# EasyEDA Pro project test_0.eprj

# Schematic Schematic1

## Sheets
1 P1: Create Date: 2024-12-12; Page Name: P1; Project Name: test_0; Schematic Name: Schematic1; Update Date: 2025-02-14; Company: 嘉立创EDA; Page Size: A4; Version: V1.0
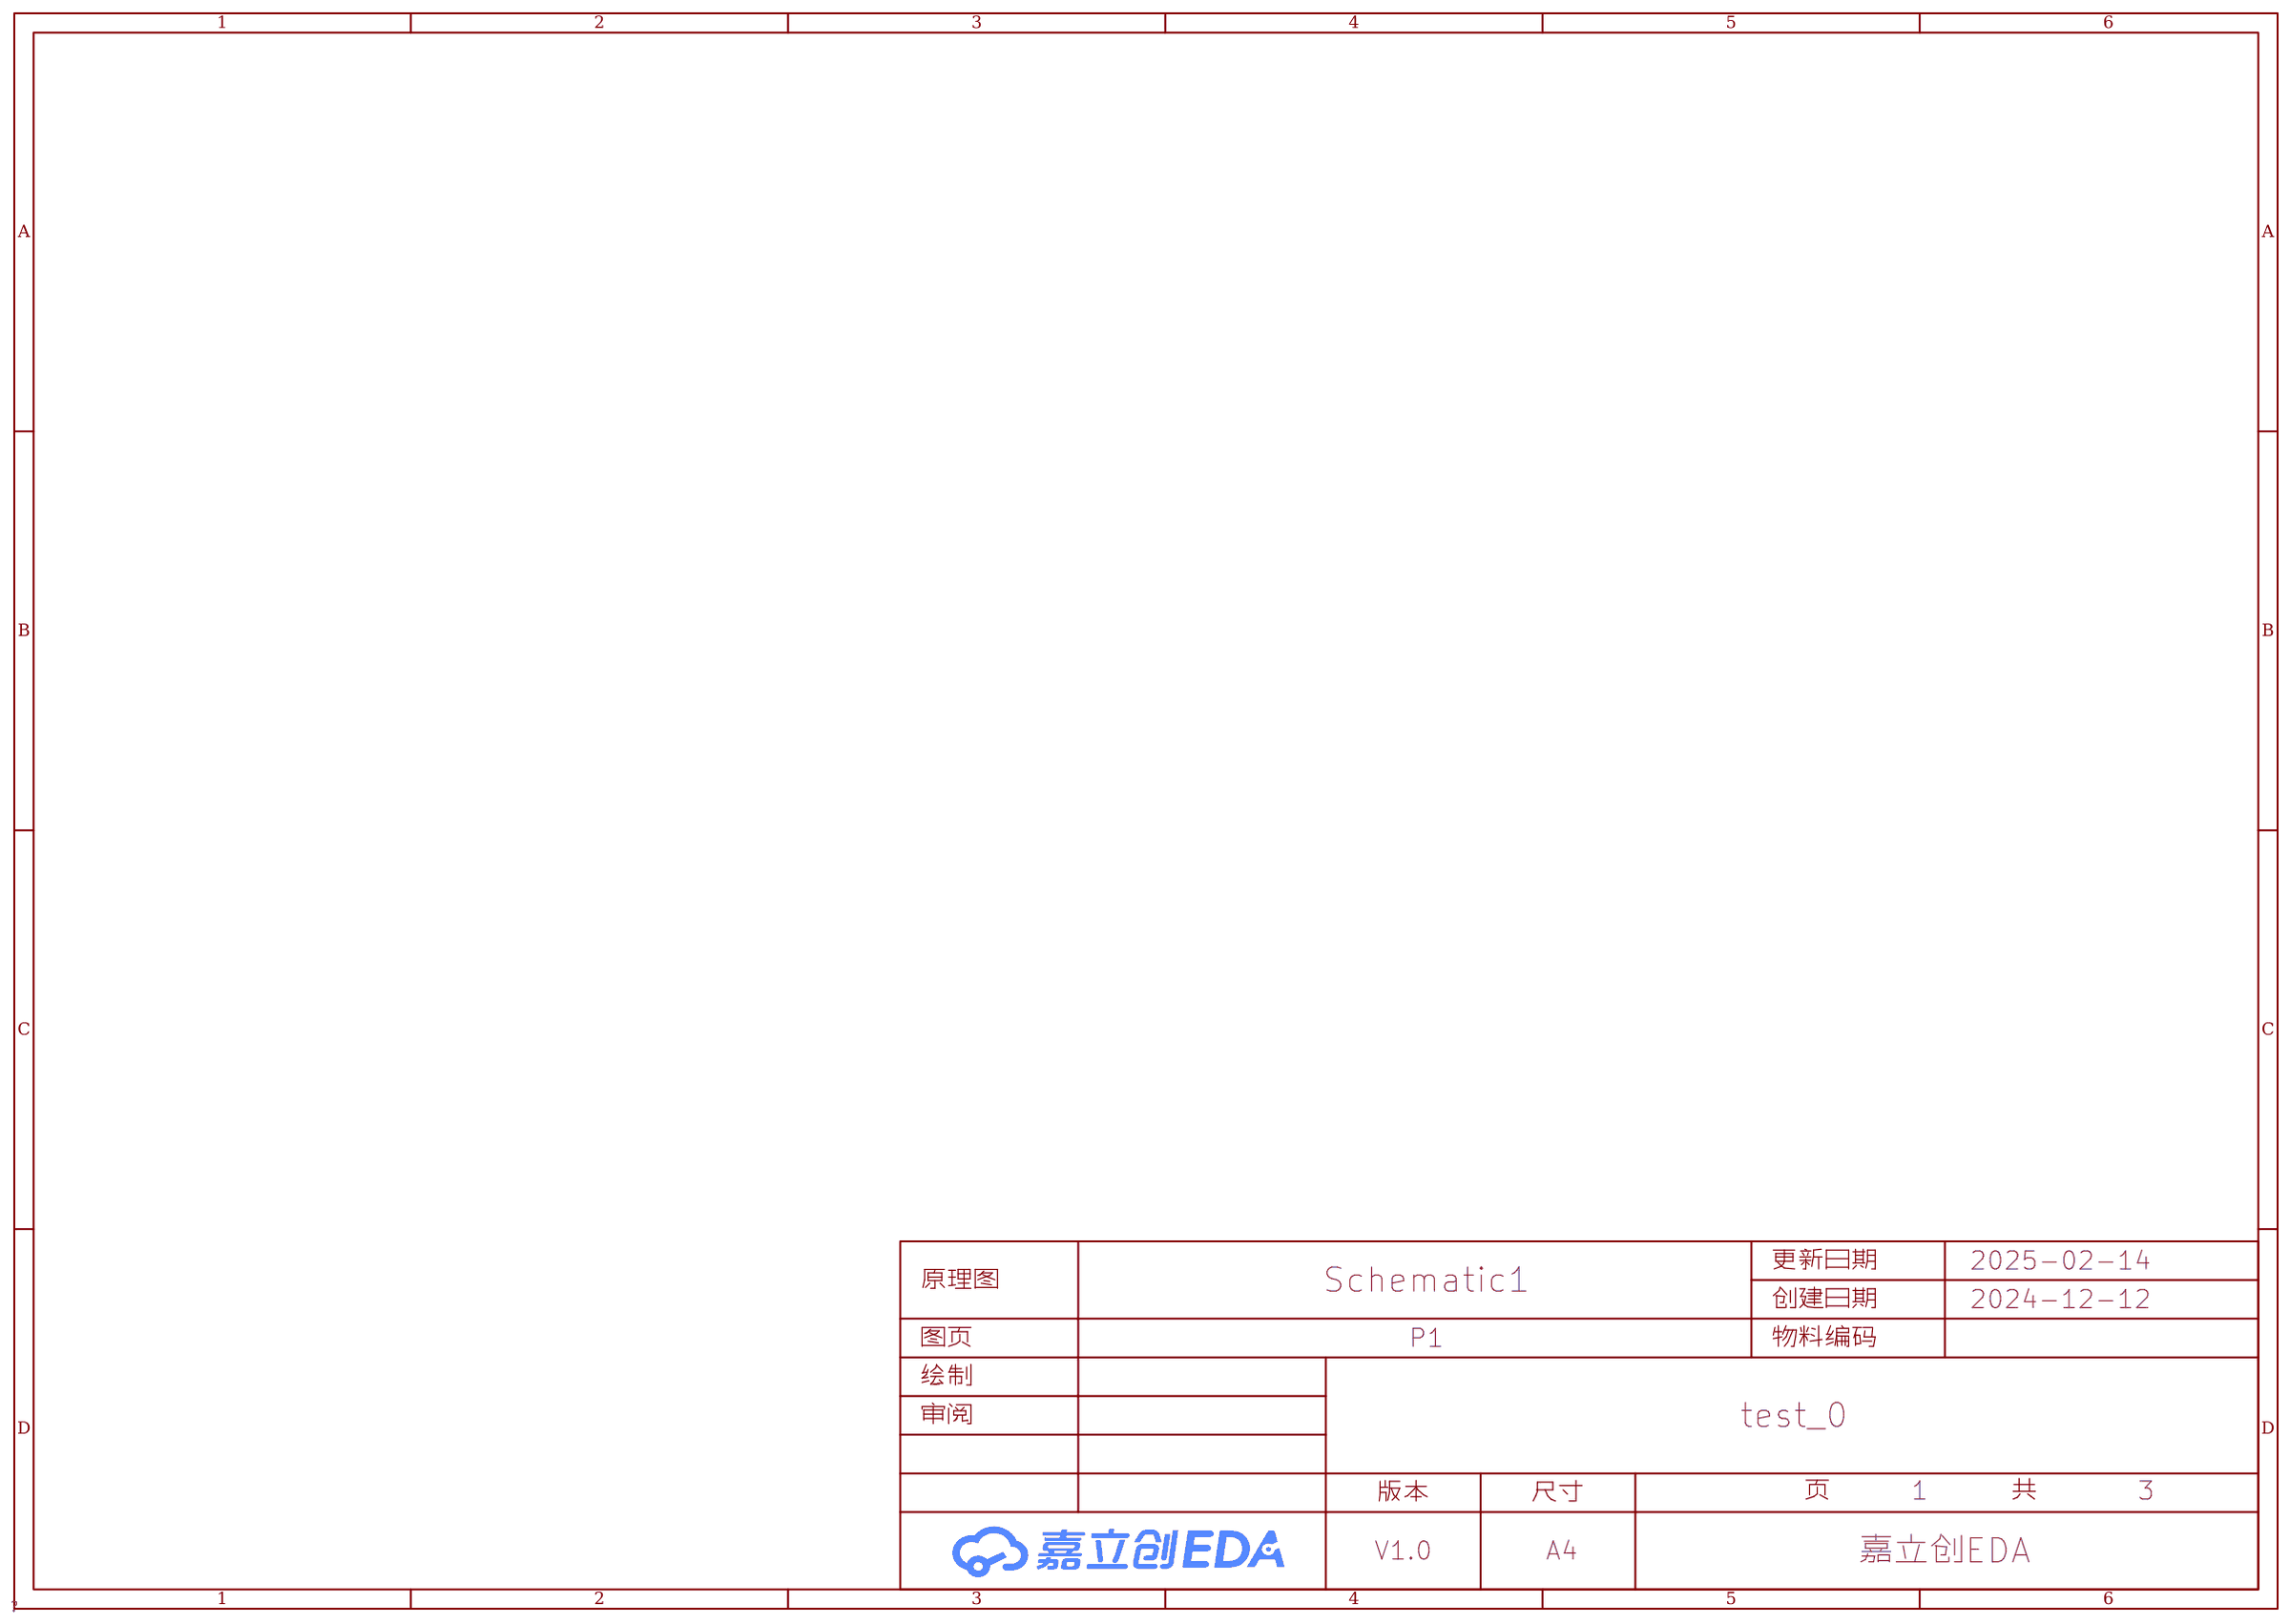
[diagram p0: P1]
2 P2: Create Date: 2024-12-15; Page Name: P2
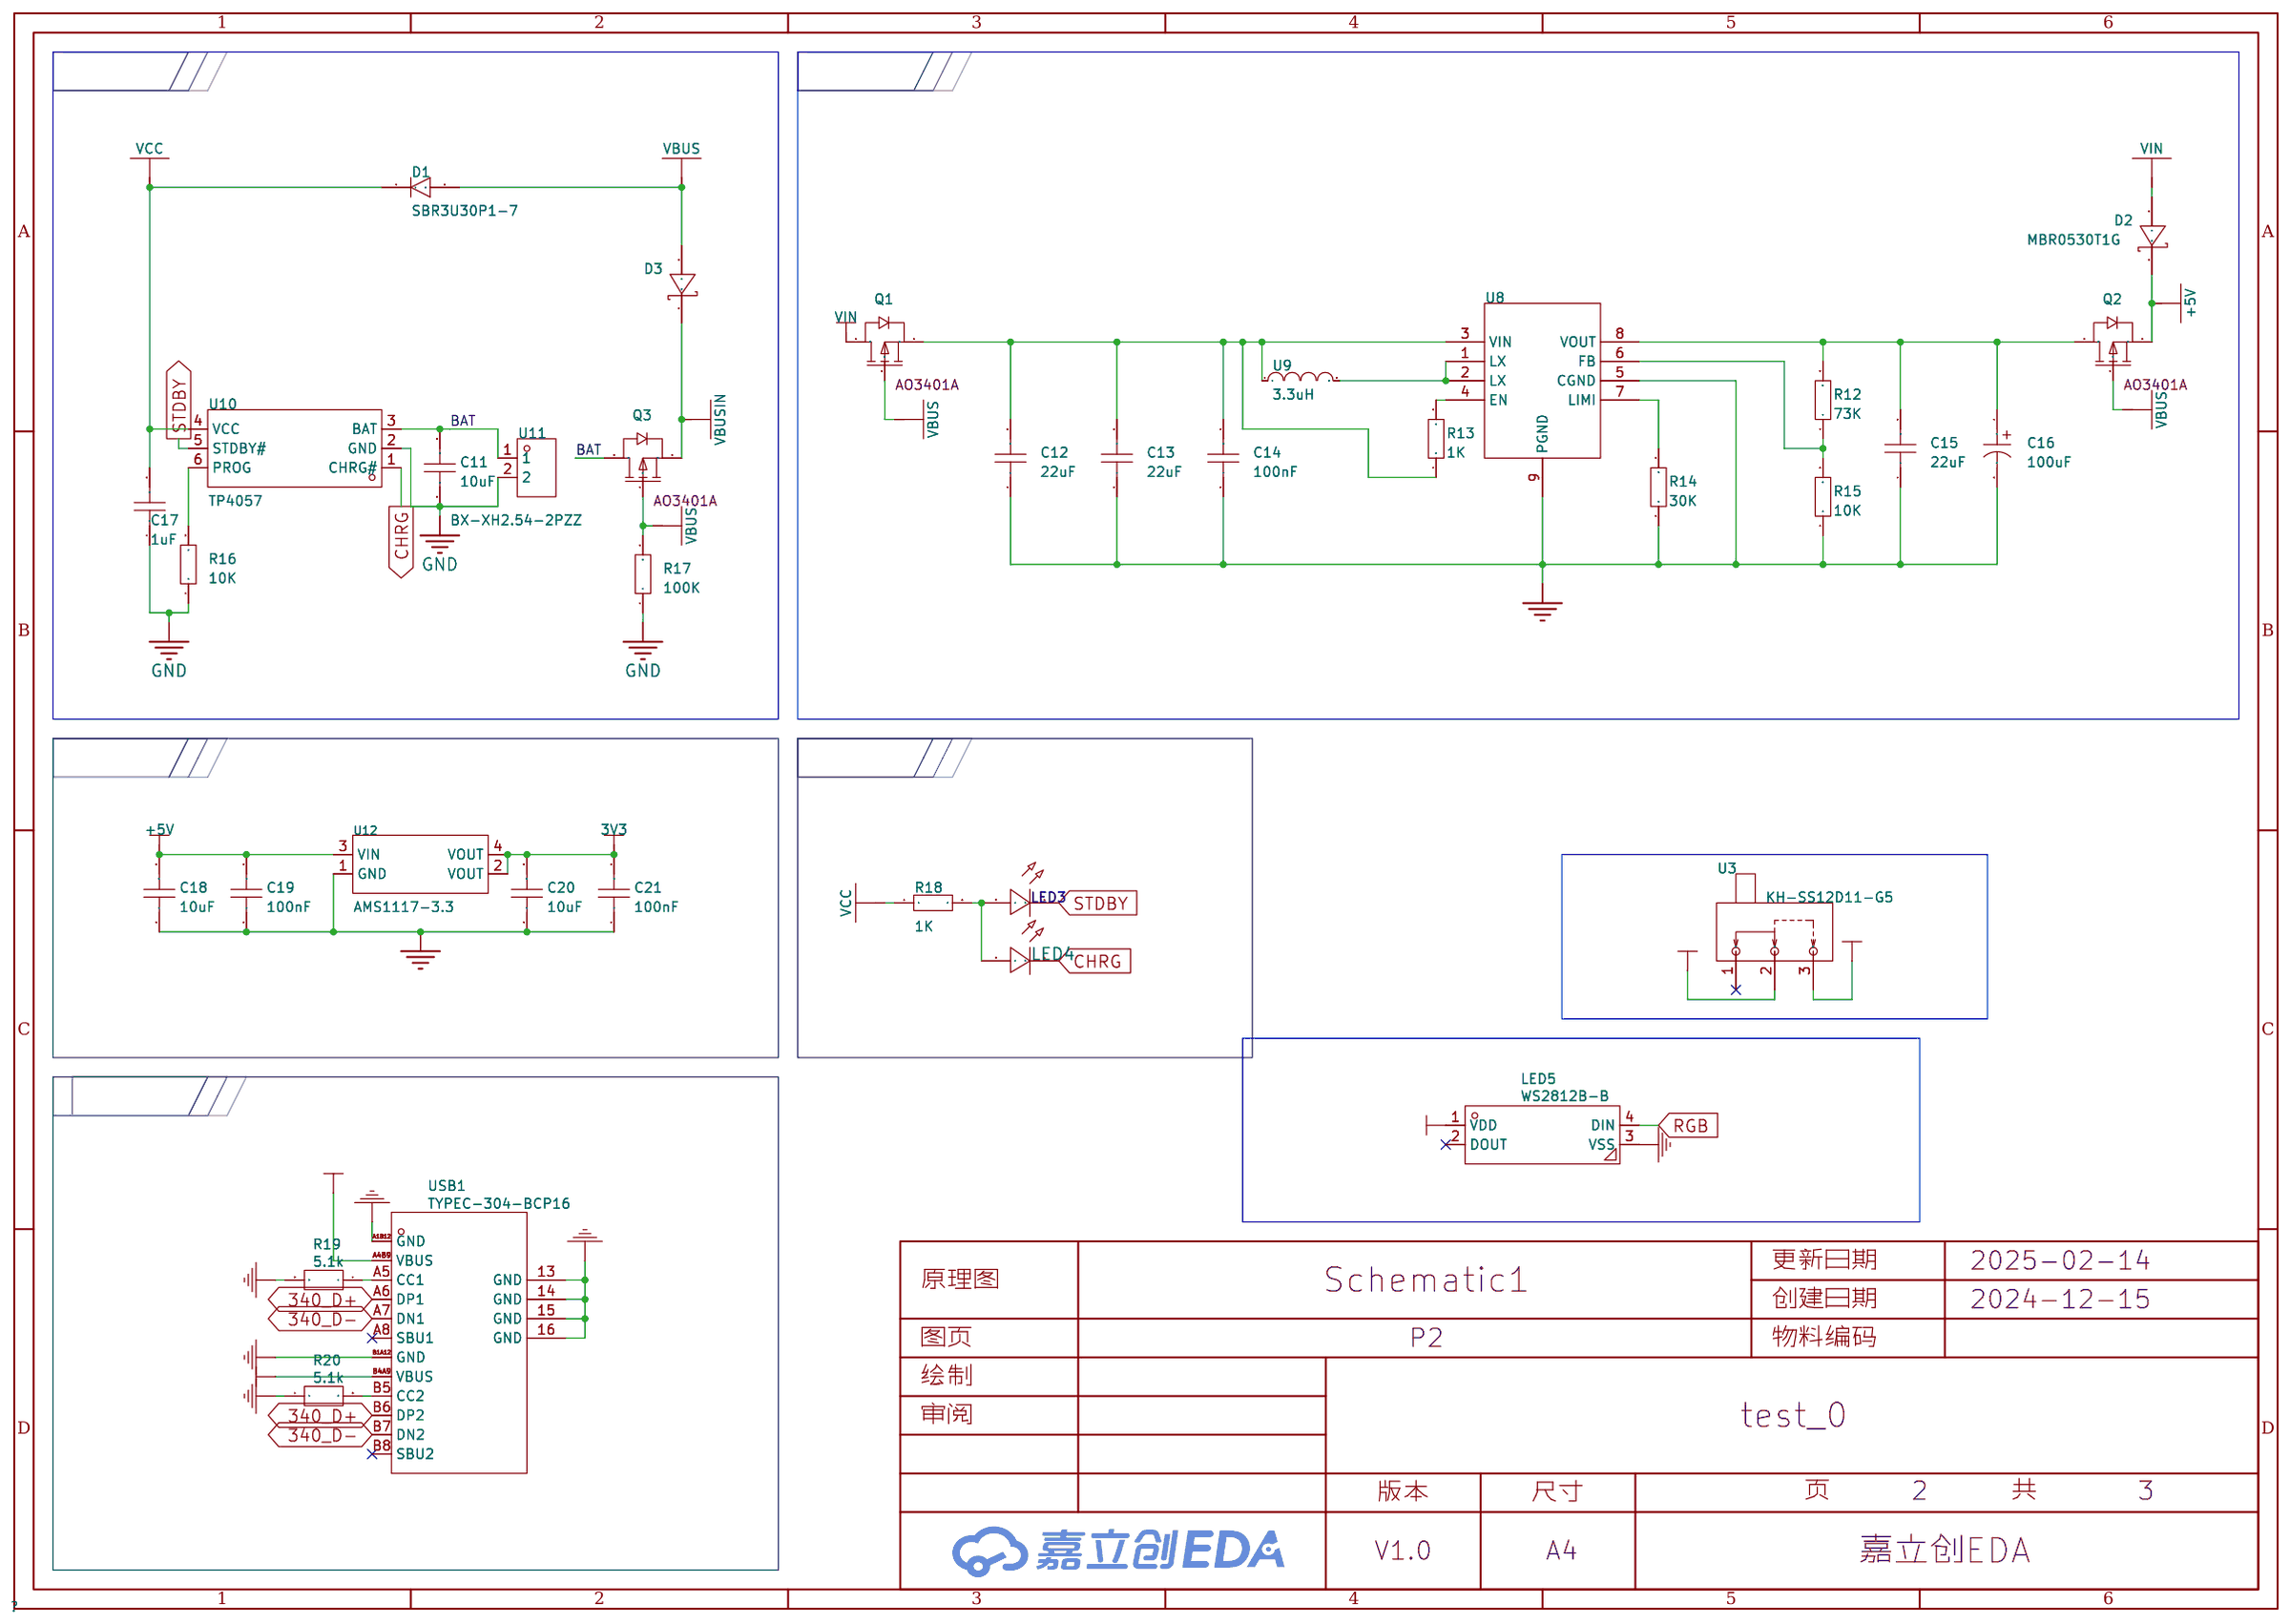
[diagram p1: P2]
3 P3: Create Date: 2025-01-15; Page Name: P3; Update Date: 2025-02-06
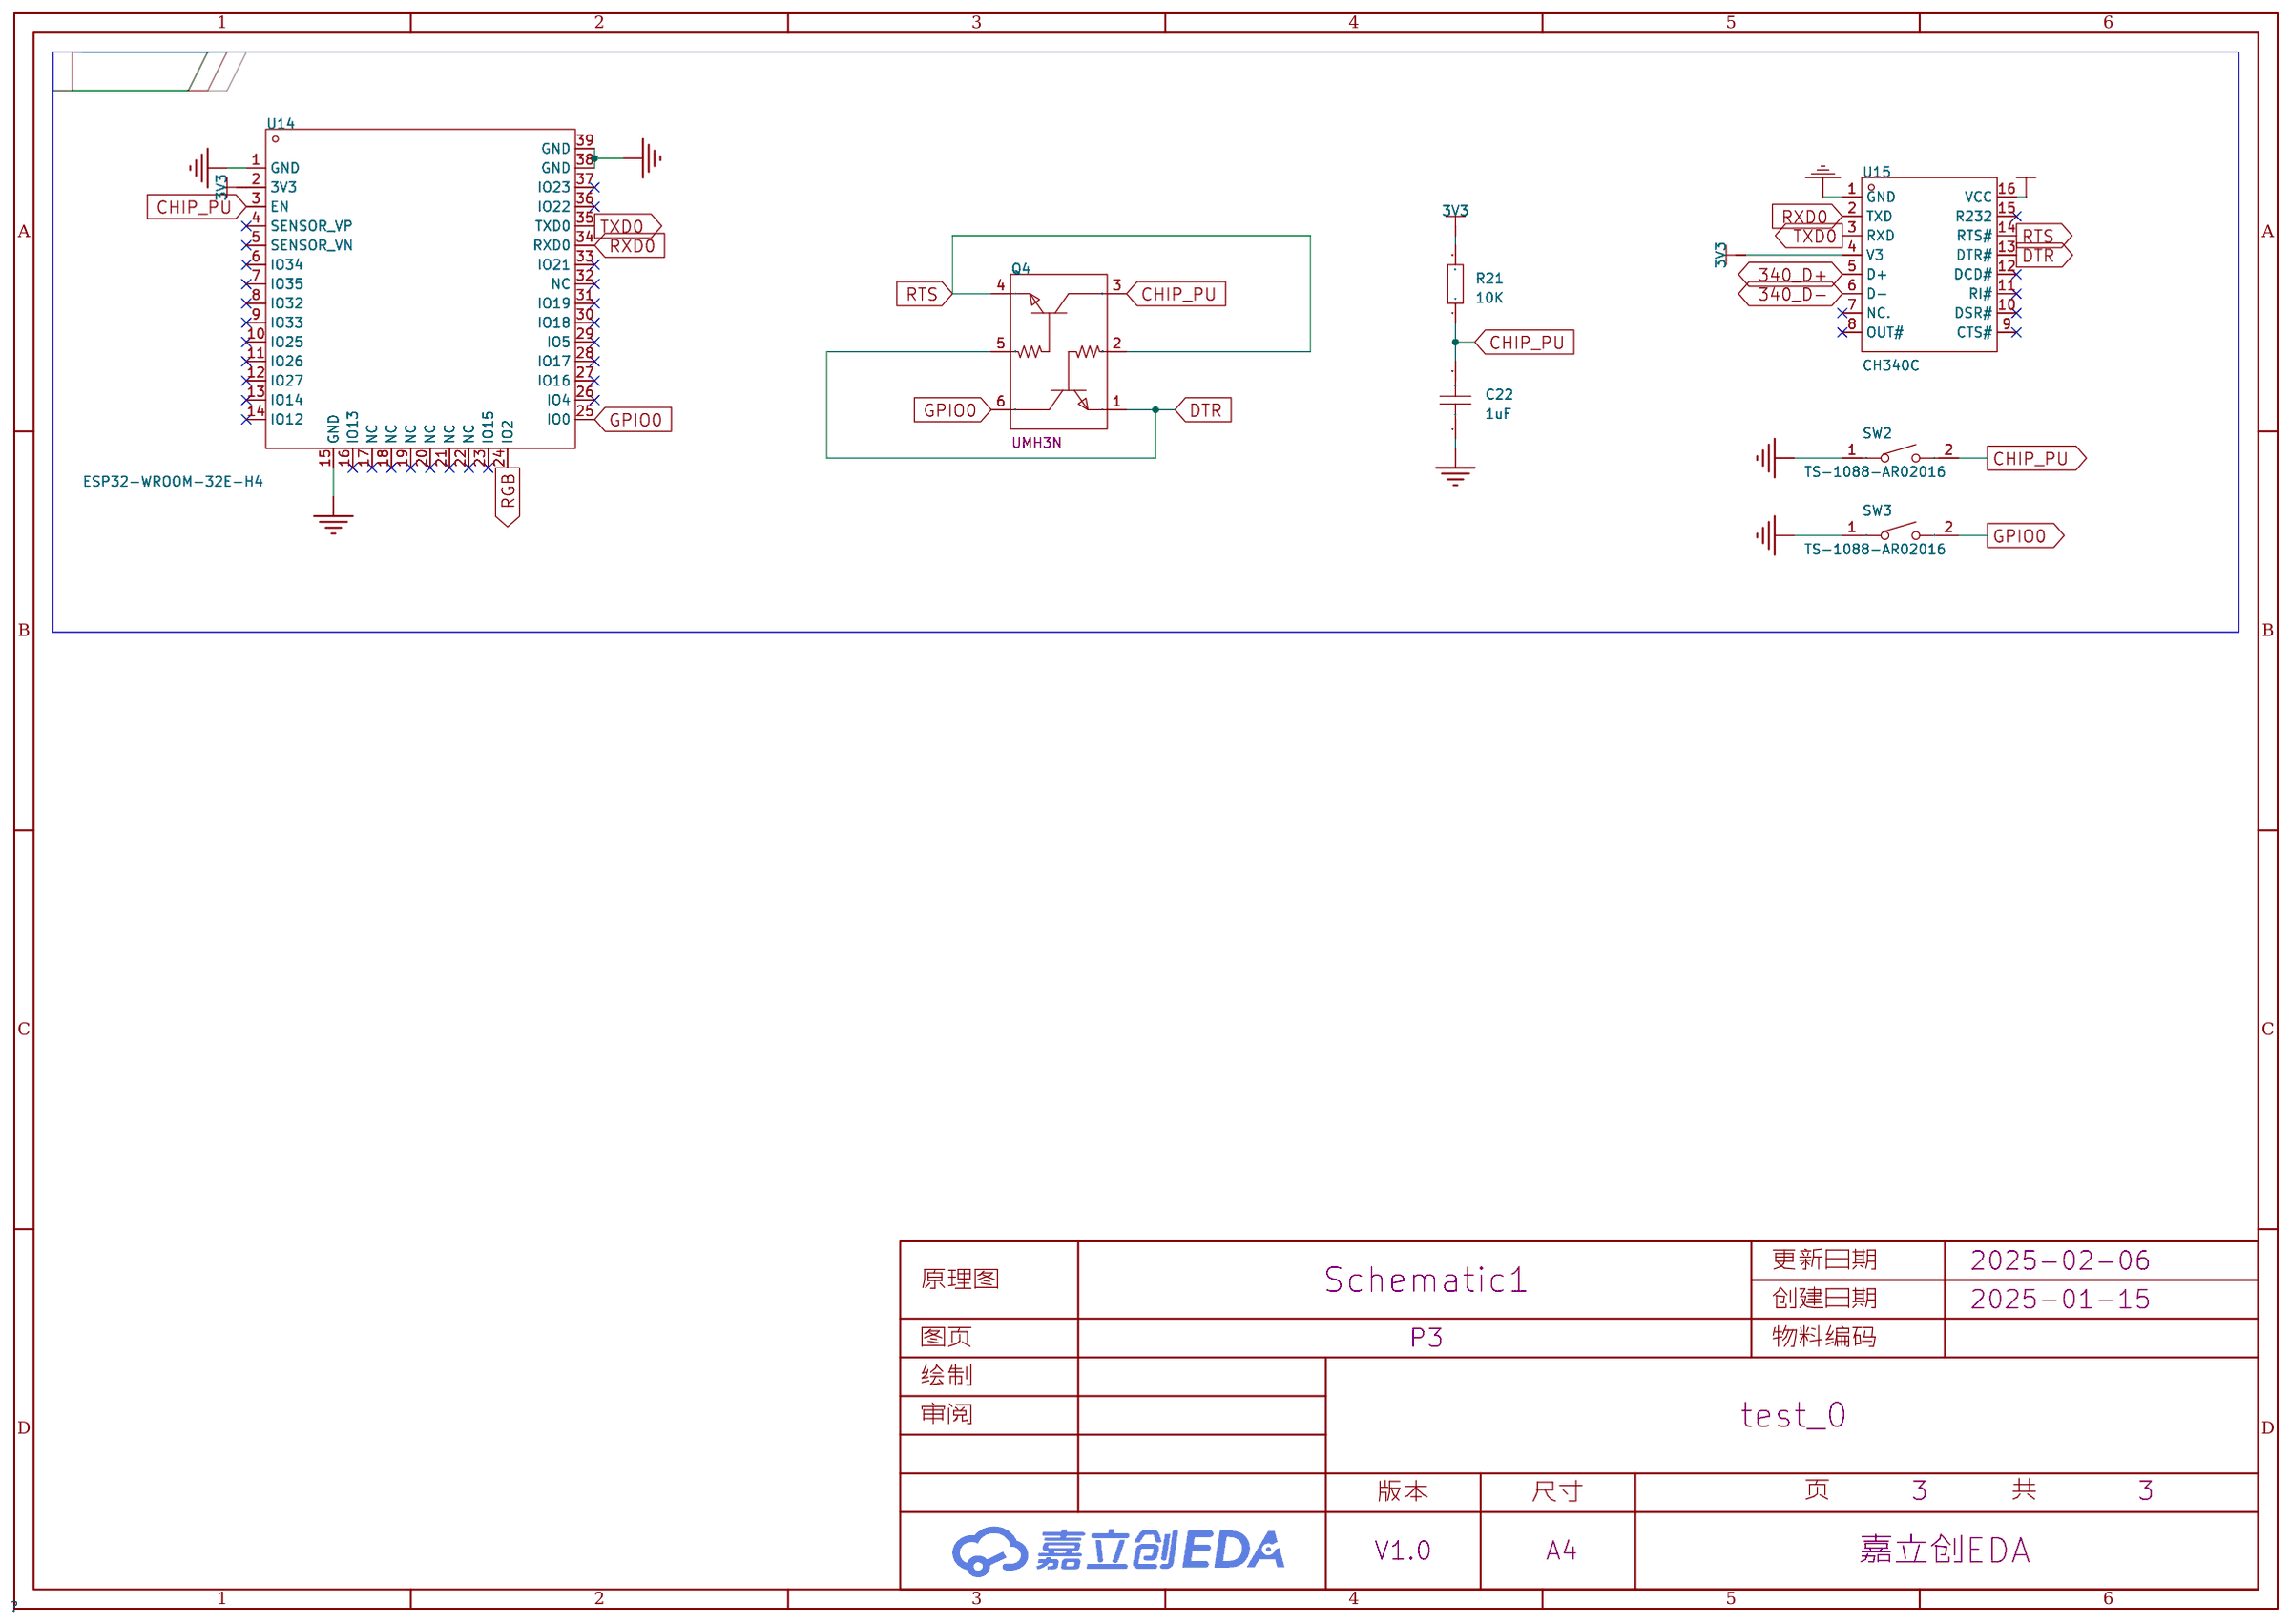
[diagram p2: P3]

## Parts
sheet P2
C11  10uF  [C0805]
C12  22uF  [C0805]
C13  22uF  [C0805]
C14  100nF  [C0805]
C15  22uF  [C0805]
C16  100uF  [CAP-TH_BD5.0-P2.00-D0.5-FD]
C17  1uF  [C0805]
C18  10uF  [C0805]
C19  100nF  [C0805]
C20  10uF  [C0805]
C21  100nF  [C0805]
D1  SBR3U30P1-7  [POWERDI-123_L2.8-W1.8-LS3.7-RD-1]
D2  MBR0530T1G  [SOD-123_L2.7-W1.6-LS3.7-RD-1]
D3  MBR0530T1G  [SOD-123_L2.7-W1.6-LS3.7-RD-1]
LED3  -  [LED_0805]
LED4  -  [LED_0805]
LED5  WS2812B-B  [LED-SMD_4P-L5.0-W5.0-BL_TC5050RGB]
Q1  -  [SOT-23-3_L2.9-W1.3-P1.90-LS2.4-BR]
Q2  -  [SOT-23-3_L2.9-W1.3-P1.90-LS2.4-BR]
Q3  -  [SOT-23-3_L2.9-W1.3-P1.90-LS2.4-BR]
R12  73K  [R0805]
R13  1K  [R0805]
R14  30K  [R0805]
R15  10K  [R0805]
R16  10K  [R0805]
R17  100K  [R0805]
R18  1K  [R0805]
R19  5.1k  [R0805]
R20  5.1k  [R0805]
U3  KH-SS12D11-G5  [SW-TH_KH-SS12D11-G5]
U8  -  [ESOP-8_L4.9-W3.9-P1.27-LS6.0-BL-EP3.1-1]
U9  3.3uH  [IND-SMD_L7.0-W6.6]
U10  TP4057  [SOT-23-6_L2.9-W1.6-P0.95-LS2.8-BR]
U11  BX-XH2.54-2PZZ  [CONN-TH_2P-P2.50_BX-XH2.54-2PZZ]
U12  AMS1117-3.3  [SOT-223-3_L6.7-W3.7-P2.30-LS7.0-BR]
USB1  TYPEC-304-BCP16  [USB-C-SMD_TYPEC-304-BCP16]
sheet P3
C22  1uF  [C0805]
Q4  UMH3N  [SC-70-6_L2.2-W1.3-P0.65-LS2.1-BR]
R21  10K  [R0805]
SW2  TS-1088-AR02016  [SW-SMD_L3.9-W3.0-P4.45]
SW3  TS-1088-AR02016  [SW-SMD_L3.9-W3.0-P4.45]
U14  ESP32-WROOM-32E-H4  [WIFI-SMD_ESP32-WROOM-32E]
U15  CH340C  [SOP-16_L10.0-W3.9-P1.27-LS6.0-BL]

## Library data of the parts
C11-C15 C17-C22 = CAP_0805: Supplier Footprint: 0805
C16 = UFW1C101MDD1TD: 容值:100uF;精度:±20%;额定电压:16V;纹波电流:155mA@120Hz;; LCSC Part Name: 100uF ±20% 16V; Supplier Part: C1579345; Manufacturer: Nichicon(尼吉康); Supplier Footprint: 插件; Datasheet: https://atta.szlcsc.com/upload/public/pdf/source/20240311/7EB34D233ACCD34112698C000C3073DF.pdf; Supplier: LCSC; Tolerance: ±20%; Rated Voltage: 16V; Ripple Current: 155mA@120Hz; Lead Spacing: 2.5mm; φD: 5mm; Lifetime @ Temp: 2000hrs@85℃; Operating Temperature: -40℃~+85℃
D1 = SBR3U30P1-7: 二极管配置:-;正向压降(Vf):390mV@3A;直流反向耐压(Vr):30V;平均整流电流(Io):3A;; LCSC Part Name: 电压:30V 电流:3A; Supplier Part: C110517; Manufacturer: DIODES(美台); Supplier Footprint: PowerDI-123; Datasheet: https://atta.szlcsc.com/upload/public/pdf/source/20170427/1493286400908.pdf; Supplier: LCSC; Forward Voltage (Vf) @ If: 390mV@3A; Reverse Voltage (Vr): 30V; Average Rectified Current (Io): 3A; Reverse Leakage Current: 150uA@30V
D2 D3 = MBR0530T1G: 正向压降(Vf):430mV@500mA;直流反向耐压(Vr):30V;平均整流电流(Io):500mA;; LCSC Part Name: 电压:30V 电流:500mA; Supplier Part: C82046; Manufacturer: onsemi(安森美); Supplier Footprint: SOD-123; Datasheet: https://atta.szlcsc.com/upload/public/pdf/source/20190903/C236079_423CC232CDF653D3C1D51633B66DAE1D.pdf; Supplier: LCSC; Forward Voltage (Vf@If): 430mV@500mA; Reverse Voltage (Vr): 30V; Average Rectified Current (Io): 500mA; Reverse Leakage Current (Ir): 130uA@30V
LED3 = LED_0805-G: Supplier Footprint: 0805
LED4 = LED_0805-R: Supplier Footprint: 0805
LED5 = WS2812B-B: Supplier: LCSC; Manufacturer: worldsemi; Manufacturer Part: WS2812B-B/W; Supplier Part: C114586; JLCPCB Part Class: Extended Part; link: https://so.szlcsc.com/global.html?k=C114586&amp;ref=editor
Q1-Q3 = AO3401A: 类型:P沟道;漏源电压(Vdss):30V;连续漏极电流(Id):4.2A;功率(Pd):1W;导通电阻(RDS(on)@Vgs,Id):65mΩ@10V,3A;阈值电压(Vgs(th)@Id):1.5V@250A;; LCSC Part Name: P沟道 30V 4.2A; Supplier Part: C700954; Manufacturer: HUASHUO(华朔); Supplier Footprint: SOT-23; JLCPCB Part Class: Extended Part; Datasheet: https://atta.szlcsc.com/upload/public/pdf/source/20200713/C700954_50D0EF28D145CDC0B45B48010B096AD0.pdf; Supplier: LCSC; Type: P沟道; Drain Source Voltage (Vdss): 30V; Continuous Drain Current (Id): 4.2A; Power Dissipation (Pd): 1W; Drain Source On Resistance (RDS(on)@Vgs,Id): 65mΩ@10V,3A; Gate Threshold Voltage (Vgs(th)@Id): 1.5V@250A
R12-R18 R21 = Res_0805: Supplier Footprint: 0805
R19 R20 = 5.1k: link: https://item.szlcsc.com/142685.html; 3DModel: R0805_L2.0-W1.3-H0.6
U3 = KH-SS12D11-G5: LCSC Part Name: 拨动开关 KH-SS12D11-G5; Supplier Part: C5274459; Manufacturer: kinghelm(金航标); Supplier Footprint: 插件; Datasheet: https://atta.szlcsc.com/upload/public/pdf/source/20221118/D3EA06F056896B32E96D61E050F18673.pdf; Supplier: LCSC
U8 = PW5303
U9 = XR0630-3R3M: 电感值:3.3uH;精度:±20%;额定电流:8.5A;饱和电流(Isat):9.5A;类型:一体成型电感;; LCSC Part Name: 3.3uH ±20% 9.5A; Supplier Part: C5307629; Manufacturer: XR(祥如); Supplier Footprint: SMD,0630; Datasheet: https://atta.szlcsc.com/upload/public/pdf/source/20240328/E34CB2E38BB86D6F3C49FFE3A7D9A071.pdf; Supplier: LCSC; Tolerance: ±20%; Rated Current: 8.5A; Saturation Current (Isat): 9.5A; DC Resistance (DCR): 22mΩ; Type: 一体成型电感
U10 = TP4057: 电源电压:6.5V;最大充电电流:500mA;电池类型:锂离子/聚合物;电池节数:1;; Supplier Part: C725791; Manufacturer: UMW(友台半导体); Supplier Footprint: SOT-23-6; Datasheet: https://atta.szlcsc.com/upload/public/pdf/source/20231109/7FB39B0490CD1514A6792371FCA0BB30.pdf; Supplier: LCSC; Supply Voltage: 6.5V; Maximum Charge Current: 500mA; Type of Battery: 锂离子/聚合物; Number of Cells: 1; Operating Temperature: -40℃~+85℃
U11 = BX-XH2.54-2PZZ: 插针结构:1x2P;间距:2.54mm;安装方式:直插;参考系列:XH;总PIN数:2P;排数:1;每排PIN数:2;行距:-;额定电流:3A;触头材质:黄铜;触头镀层:锡;工作温度范围:-25℃~+85℃;; Supplier Part: C18077833; Manufacturer: Bossie(博锡); Supplier Footprint: 插件,P=2.54mm; Datasheet: https://atta.szlcsc.com/upload/public/pdf/source/20231017/CB25E46A13930659CD6CDE2F2553A508.pdf; Supplier: LCSC; Pins Structure: 1x2P; Pitch: 2.54mm; Mounting Style: 直插; Reference Series: XH; Number of Pins: 2P; Number of Rows: 1; Number of PINs Per Row: 2; Current Rating (Max): 3A; Contact Material: 黄铜; Contact Plating: 锡; Operating Temperature Range: -25℃~+85℃
U12 = AMS1117-3.3_C18164485: 输出类型:固定;最大输入电压:18V;输出电压:3.3V;最大输出电流:1A;电源纹波抑制比(PSRR):60dB@(120Hz);输出极性:正极;; Supplier Part: C18164485; Manufacturer: GR(国睿); Supplier Footprint: SOT-223; Datasheet: https://atta.szlcsc.com/upload/public/pdf/source/20230915/94CBA0DE456537EBE1AFE762E38F0E43.pdf; Supplier: LCSC; Output Type: 固定; Maximum Input Voltage: 18V; Output Voltage: 3.3V; MAX Output Current: 1A; Power Supply Rejection Ratio (PSRR): 60dB@(120Hz); Output Polarity: 正极
USB1 = TYPEC-304-BCP16: link: https://item.szlcsc.com/763636.html?ref=editor&logined=true; Supplier: LCSC; Supplier Part: C720629; Manufacturer: XUNPU(讯普); JLCPCB Part Class: Extended Part
Q4 = UMH3N: 晶体管类型:2个NPN-预偏置;功率(Pd):150mW;集电极电流(Ic):100mA;集射极击穿电压(Vceo):50V;; LCSC Part Name: 2个NPN-预偏置 100mA 50V; Supplier Part: C62892; Manufacturer: CJ(江苏长电/长晶); Supplier Footprint: SC-70-6(SOT-363); JLCPCB Part Class: Extended Part; Datasheet: https://atta.szlcsc.com/upload/public/pdf/source/20151109/1457707575095.pdf; Supplier: LCSC; Transistor Type: 2个NPN-预偏置; Power Dissipation (Pd): 150mW; Collector Current (Ic): 100mA; Collector-Emitter Breakdown Voltage (Vceo): 50V
SW2 SW3 = TS-1088-AR02016: 电路结构:单刀单掷;按钮形状:圆形按钮;作用力:160gf;安装方式:立贴;开关长度:4mm;开关宽度:3mm;开关高度:2mm;带支架:不带;触点电流:50mA;额定电压(DC):12V;绝缘电阻:100MΩ;机械寿命:10万次;; LCSC Part Name: 4*3*2mm 立贴 轻触开关; Supplier Part: C720477; Manufacturer: XUNPU(讯普); Supplier Footprint: SMD; Datasheet: https://atta.szlcsc.com/upload/public/pdf/source/20200810/C720475_60D09DD6C54279ADDB2DC25100F1CC11.pdf; Supplier: LCSC; Circuit: 单刀单掷; Actuator Style: 圆形按钮; Operating Force: 160gf; Mounting Style: 立贴; Switch Length: 4mm; Switch Width: 3mm; Switch Height: 2mm; Strike Gundam: 不带; Contact Current: 50mA; Voltage Rating (DC): 12V; Insulation Resistance: 100MΩ; Actuator/Cap Color: 黑色; Pin Style: SMD接片; Mechanical Life: 10万次; Operating Temperature: -30℃~+80℃